# EasyEDA Pro project 第十五届蓝桥杯EDA赛项模拟试题二（嘉立创EDA提供）.eprj, board PCB-PockerMultimater1
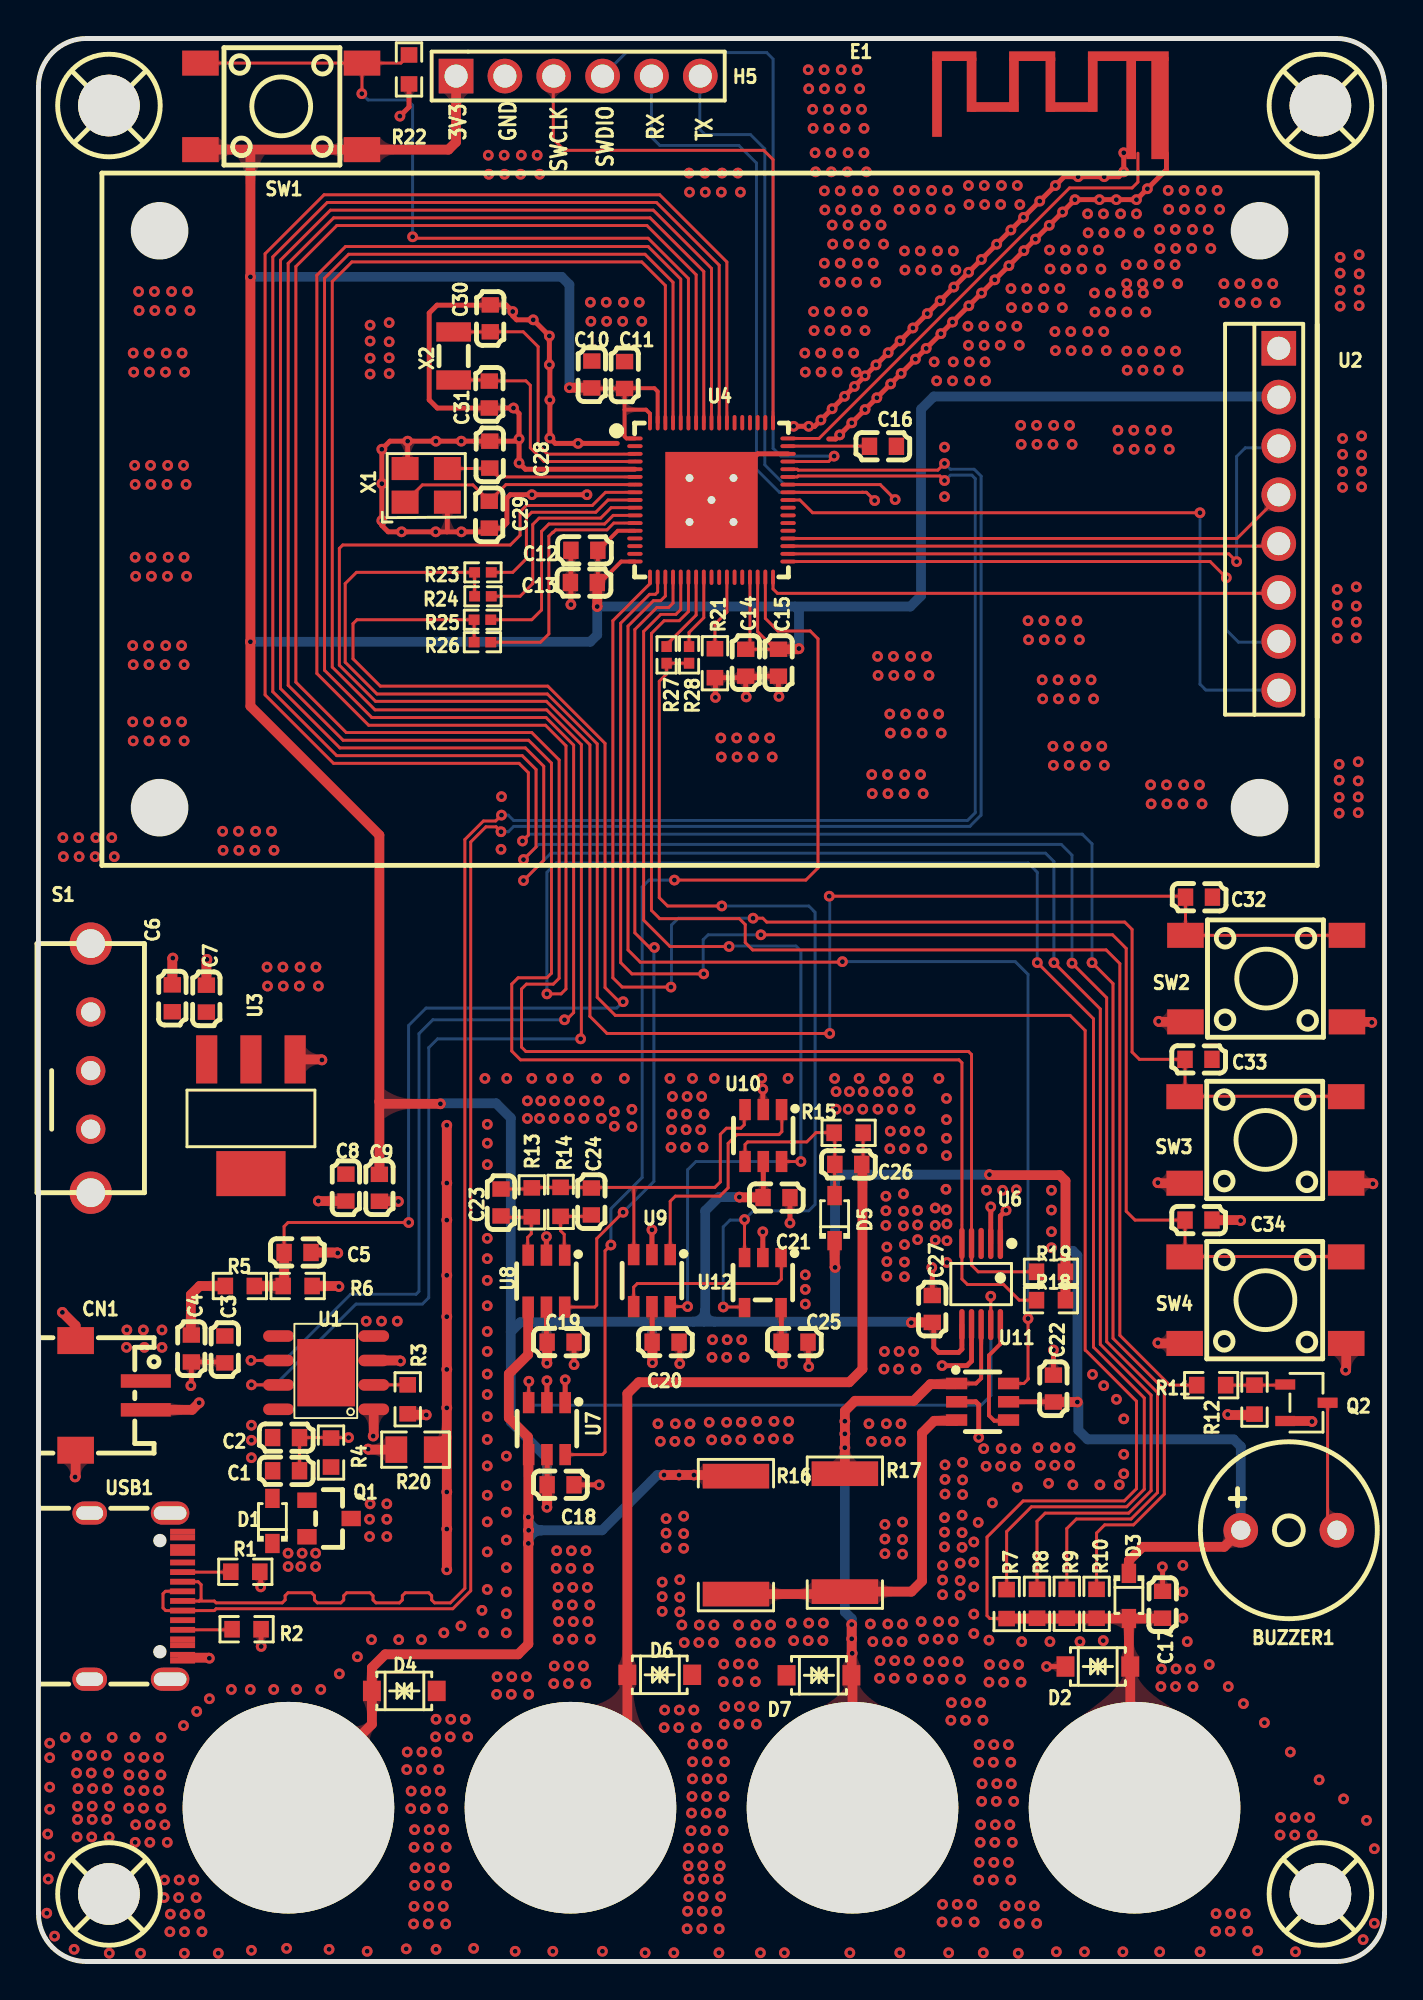
[diagram p1: board, top side]
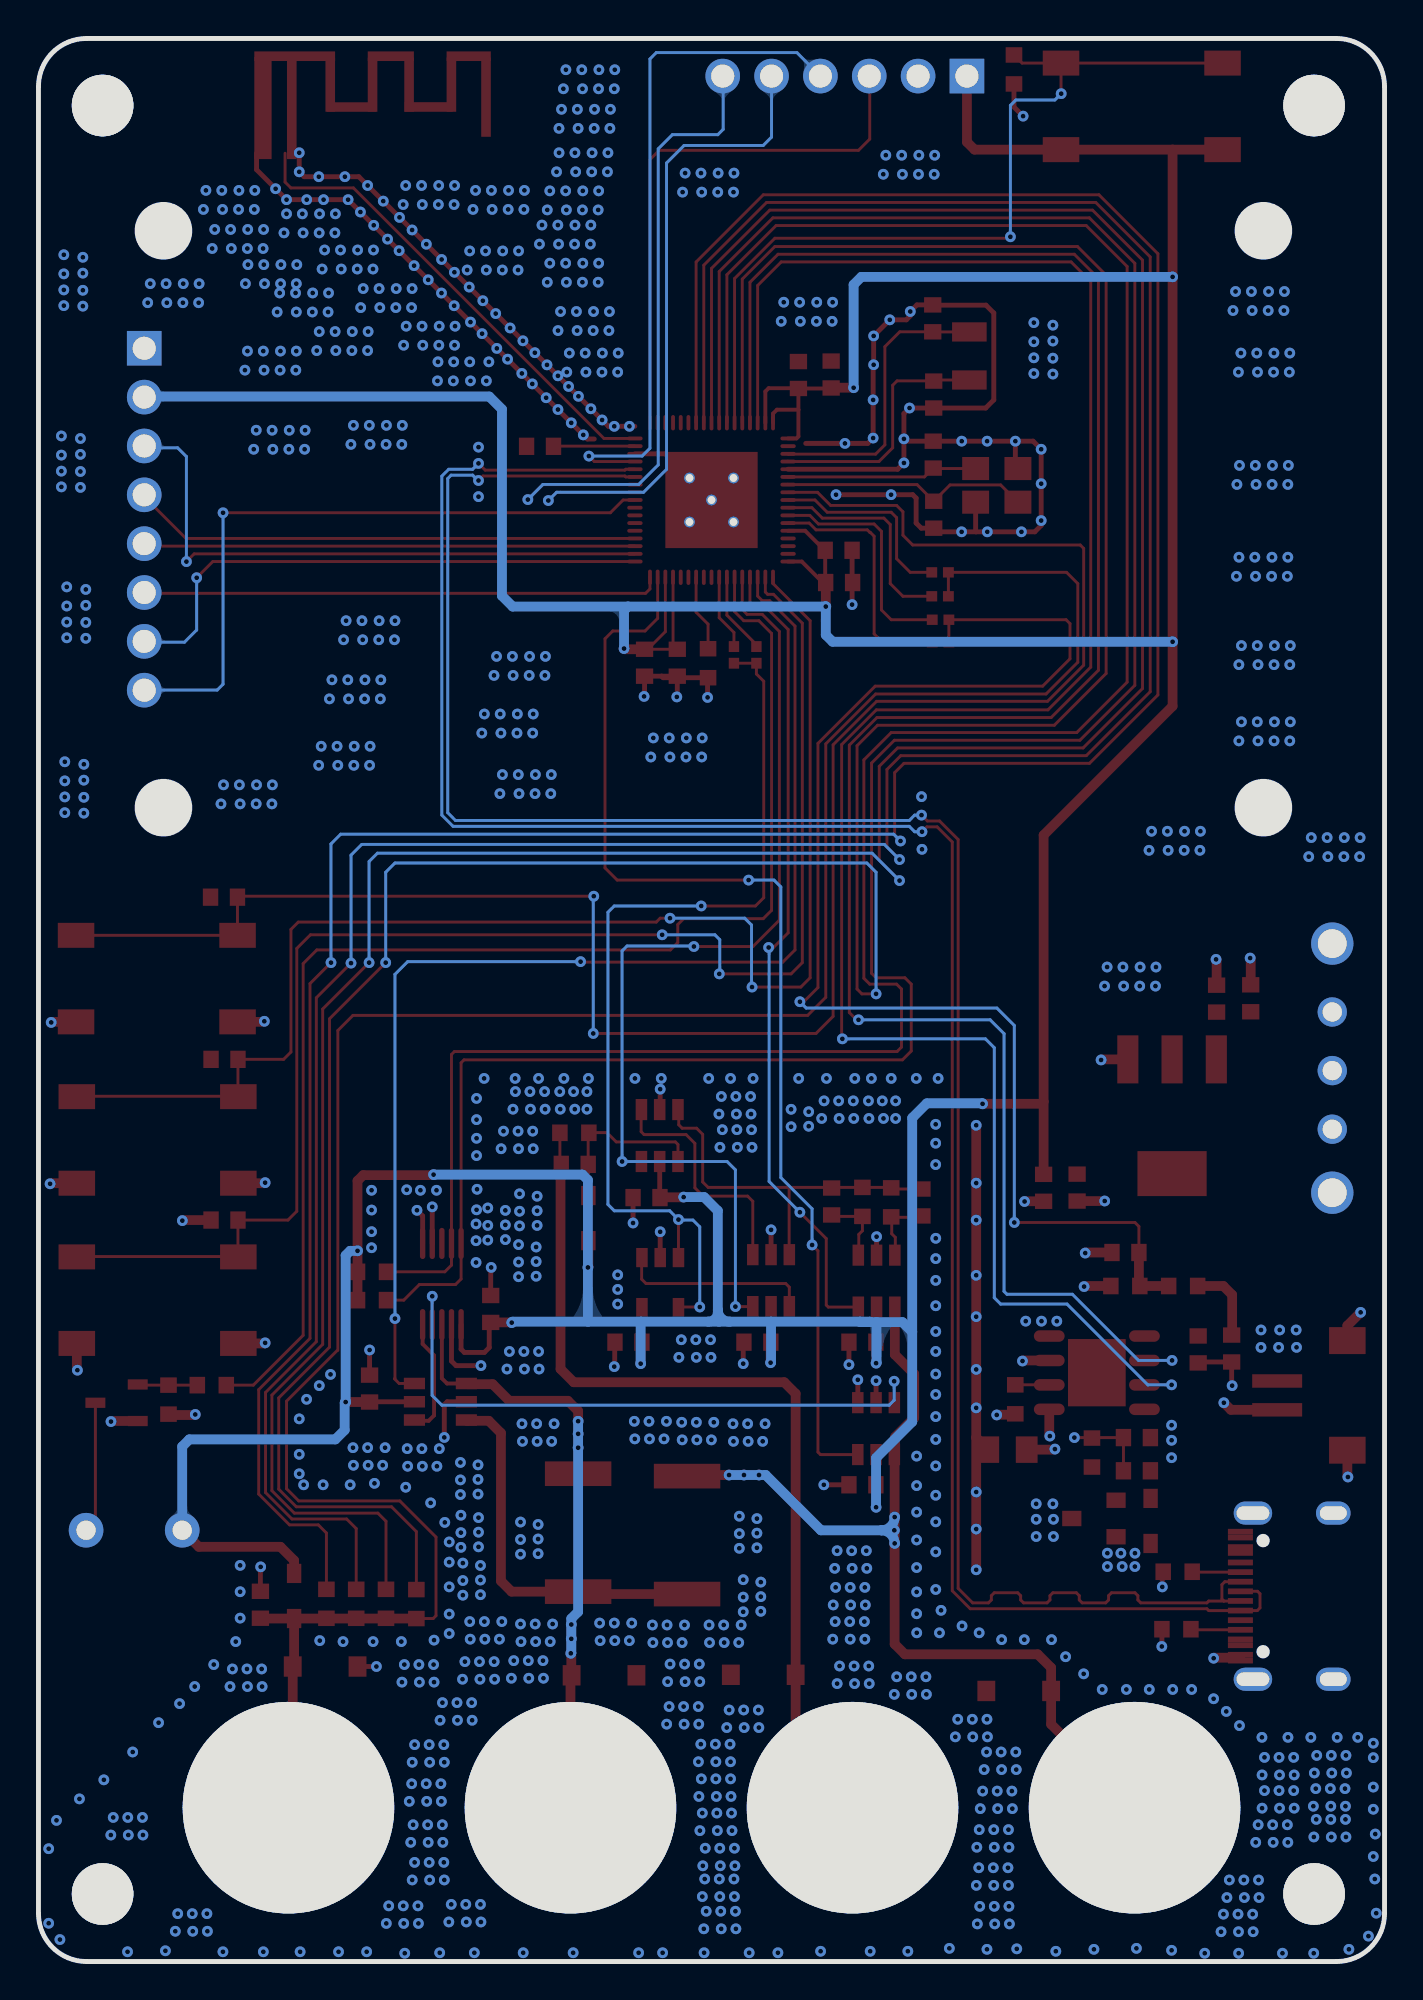
[diagram p2: board, bottom side, seen from below]

Outline 70 x 100 mm; copper layers: Top Layer, Bottom Layer. Coordinates in mm from the lower left corner of the outline.
Outline path: 0,97.5 0,2.5 arc(0.73,0.73) 2.5,0 67.5,0 arc(69.27,0.73) 70,2.5 70,97.5 arc(69.27,99.27) 67.5,100 2.5,100 arc(0.73,99.27) 0,97.5
Stack: Top Layer 0.035mm / Dielectric1 1.51mm FR4 er 4.5 / Bottom Layer 0.035mm

## Design rules (mm)
net VIN: power
net GND: power
net VBUS: power
net USB1DM: DP1
net USB1DP: DP1
net 3V3: power
net VBAT: power
net +5V: power
net AGND: power
template: 自定义配置
spacing copperThickness1oz (default): track to track 0.152, other pairs 0.152 to 0.152
spacing copperThickness2oz: track to track 0.203, other pairs 0.152 to 0.3
spacing ANT: track to track 0.152, other pairs 0 to 0.3
track width copperThickness1oz (default): min 0.152, default 0.152, max 2.54
track width copperThickness2oz: min 0.203, default 0.254, max 2.54
track width power: min 0.152, default 0.254, max 2.54
differential pair differentialPair (default): width min 0.152, default 0.152, max 0.152; gap min 0.152, default 0.152
via viaSize (default): diameter min 0.559, default 0.559, max 0.559; hole min 0.254, default 0.254, max 0.254
net class power uses power
net VIN uses power
net GND uses power
net VBUS uses power
net 3V3 uses power
net VBAT uses power
net +5V uses power
net AGND uses power

## Placement (name value [footprint] x y rotation side)
BUZZER1  3kHz  [BUZ-TH_BD9.0-P5.00-D0.6-FD]  65.02 22.43 0 top
C1  10uF  [C0603]  12.88 25.52 180 top
C2  100nF  [C0603]  12.88 27.25 180 top
C3  10uF  [C0603]  9.69 31.83 90 top
C4  100nF  [C0603]  7.95 31.88 90 top
C5  100nF  [C0603]  13.47 36.87 0 top
C6  10uF  [C0603]  6.96 50.09 270 top
C7  100nF  [C0603]  8.73 50.07 90 top
C8  10uF  [C0603]  15.99 40.25 90 top
C9  100nF  [C0603]  17.73 40.23 270 top
C10  100nF  [C0603]  28.78 82.52 90 top
C11  100nF  [C0603]  30.48 82.5 270 top
C12  100nF  [C0603]  28.39 73.39 180 top
C13  100nF  [C0603]  28.36 71.71 180 top
C14  100nF  [C0603]  36.78 67.54 270 top
C15  100nF  [C0603]  38.48 67.54 270 top
C16  1uF  [C0603]  43.92 78.79 0 top
C17  100nF  [C0603]  58.46 18.55 270 top
C18  100nF  [C0603]  27.15 24.79 0 top
C19  100nF  [C0603]  27.15 32.21 0 top
C20  100nF  [C0603]  32.61 32.21 0 top
C21  100nF  [C0603]  38.38 39.73 0 top
C22  100nF  [C0603]  52.78 29.79 90 top
C23  100nF  [C0603]  24.05 39.47 90 top
C24  100nF  [C0603]  28.75 39.52 90 top
C25  100nF  [C0603]  39.32 32.21 0 top
C26  100nF  [C0603]  42.11 41.45 180 top
C27  100nF  [C0603]  46.48 33.93 90 top
C28  12pF  [C0603]  23.47 78.36 90 top
C29  12pF  [C0603]  23.44 75.23 90 top
C30  12pF  [C0603]  23.5 85.45 90 top
C31  12pF  [C0603]  23.44 81.48 270 top
C32  100nF  [C0603]  60.35 55.35 180 top
C33  100nF  [C0603]  60.32 46.91 180 top
C34  100nF  [C0603]  60.32 38.56 180 top
CN1  1.5K-BH-2PWB  [CONN-SMD_2P-P1.50_HDGC_1.5K-BH-2PWB]  3.76 29.44 270 top
D1  1N5819WS  [SOD-323_L1.8-W1.3-LS2.5-RD]  12.17 22.91 90 top
D2  SJD12C40L01  [SOD-123_L2.8-W1.8-LS3.7-BI]  55.09 15.34 0 top
D3  1N4148  [SOD-323_L1.8-W1.3-LS2.5-RD]  56.71 19.01 270 top
D4  SJD12C40L01  [SOD-123_L2.8-W1.8-LS3.7-BI]  19.02 14.07 180 top
D5  1N4148  [SOD-323_L1.8-W1.3-LS2.5-RD]  41.4 38.66 90 top
D6  SJD12C40L01  [SOD-123_L2.8-W1.8-LS3.7-BI]  32.31 14.91 180 top
D7  SJD12C40L01  [SOD-123_L2.8-W1.8-LS3.7-BI]  40.59 14.88 0 top
E1  d62bb7b376ef4f1495932ffa50be4b9b  [ANT-F-1-2.4G-1.6]  57.18 94.03 0 top
H1  -  [M3]  3.5 96.5 0 top
H2  -  [M3]  66.5 96.5 0 top
H3  -  [M3]  3.5 3.5 0 top
H4  -  [M3]  66.5 3.5 0 top
H5  2.54-1x6P直针  [HDR-TH_6P-P2.54-V-M-1]  28.07 98.04 0 top
J1  -  [香蕉头-4mm-24.302.*]  13 8 0 top
J2  -  [香蕉头-4mm-24.302.*]  27.67 8 0 top
J3  -  [香蕉头-4mm-24.302.*]  42.33 8 0 top
J4  -  [香蕉头-4mm-24.302.*]  57 8 0 top
Q1  AO3401A  [SOT-23_L2.9-W1.3-P1.90-LS2.4-BR]  15.11 23.04 180 top
Q2  S8050  [SOT-23-3_L3.0-W1.7-P0.95-LS2.9-BR]  65.94 29.06 180 top
R1  5.1kΩ  [R0603]  10.76 20.27 180 top
R2  5.1kΩ  [R0603]  10.82 17.28 180 top
R3  10kΩ  [R0603]  19.2 29.24 90 top
R4  10kΩ  [R0603]  15.21 26.47 270 top
R5  10kΩ  [R0603]  10.47 35.13 180 top
R6  10kΩ  [R0603]  13.48 35.13 180 top
R7  1kΩ  [R0603]  50.35 18.59 90 top
R8  10kΩ  [R0603]  51.93 18.6 90 top
R9  100kΩ  [R0603]  53.48 18.6 90 top
R10  1MΩ  [R0603]  55.03 18.6 90 top
R11  10kΩ  [R0603]  60.99 29.97 0 top
R12  10kΩ  [R0603]  63.24 29.22 90 top
R13  100kΩ  [R0603]  25.65 39.48 90 top
R14  1MΩ  [R0603]  27.15 39.5 90 top
R15  1MΩ  [R0603]  42.13 43.09 180 top
R16  10mΩ  [R2512]  36.27 22.17 90 top
R17  80mΩ  [R2512]  41.94 22.3 270 top
R18  4.7kΩ  [R0603]  52.65 34.39 0 top
R19  4.7kΩ  [R0603]  52.65 35.86 0 top
R20  0Ω  [R0805]  19.61 26.62 180 top
R21  10kΩ  [R0603]  35.18 67.51 270 top
R22  10kΩ  [R0603]  19.27 98.39 270 top
R23  0Ω  [R0402]  23.11 72.24 0 top
R24  0Ω  [R0402]  23.11 70.99 0 top
R25  0Ω  [R0402]  23.09 69.77 0 top
R26  0Ω  [R0402]  23.09 68.61 0 top
R27  0Ω  [R0402]  32.66 67.94 90 top
R28  0Ω  [R0402]  33.83 67.94 90 top
S1  SK-12E12-G5  [SW-TH_SK-12E12-G5]  2.72 46.46 180 top
SW1  TS-1002S-07026C  [KEY-SMD_4P-L6.0-W6.0-P4.50-LS9.0]  12.62 96.47 180 top
SW2  TS-1002S-07026C  [KEY-SMD_4P-L6.0-W6.0-P4.50-LS9.0]  63.85 51.11 0 top
SW3  TS-1002S-07026C  [KEY-SMD_4P-L6.0-W6.0-P4.50-LS9.0]  63.81 42.72 0 top
SW4  TS-1002S-07026C  [KEY-SMD_4P-L6.0-W6.0-P4.50-LS9.0]  63.81 34.39 0 top
U1  TP4056X-42-ESOP8  [TP4056-SOP8]  14.96 30.62 0 top
U2  -  [2.0寸TFT屏幕模块-8Pin]  35 75 270 top
U3  AMS1117-3.3  [SOT-223-3_L6.5-W3.4-P2.30-LS7.0-BR]  11.05 43.94 90 top
U4  7693da239a7c4f18baa0651e8e27e4a9  [QFN68(8x8)]  35 76 270 top
U6  INA226AIDGSR  [MSOP-10_L3.0-W3.0-P0.50-LS5.0-BL]  49.02 35.23 180 top
U7  SN74LVC1G3157DBVR  [SOT-23-6_L2.9-W1.6-P0.95-LS2.8-BR]  26.44 27.71 90 top
U8  SN74LVC1G3157DBVR  [SOT-23-6_L2.9-W1.6-P0.95-LS2.8-BR]  26.42 35.38 90 top
U9  SN74LVC1G3157DBVR  [SOT-23-6_L2.9-W1.6-P0.95-LS2.8-BR]  31.9 35.41 90 top
U10  SN74LVC1G3157DBVR  [SOT-23-6_L2.9-W1.6-P0.95-LS2.8-BR]  37.69 42.95 90 top
U11  SN74LVC1G3157DBVR  [SOT-23-6_L2.9-W1.6-P0.95-LS2.8-BR]  49.1 29.11 180 top
U12  LMV321IDBVR  [SOT-23-5_L3.0-W1.7-P0.95-LS2.8-BR]  37.67 35.31 90 top
USB1  KH-TYPE-C-16P  [USB-C-SMD_KH-TYPE-C-16P]  5.08 19 270 top
X1  32MHz  [OSC-SMD_4P-L3.2-W2.5-BL]  20.16 76.76 0 top
X2  32.768kHz  [FC-135R_L3.2-W1.5]  21.59 83.49 90 top

## Footprints (pads in the part's own frame, mm; a bottom-side part is the same pattern mirrored in y, then rotated)
2.0寸TFT屏幕模块-8Pin
  rect 1.8x1.8 hole 1.2: 1(-8.89,29.5)
  round 1.8 hole 1.2: 2(-6.35,29.5) 3(-3.81,29.5) 4(-1.27,29.5) 5(1.27,29.5) 6(3.81,29.5) 7(6.35,29.5) 8(8.89,29.5)
ANT-F-1-2.4G-1.6
  rect 0.8x0.6 smd: 0(1.143,0)
  rect 0.4x0.6 smd: 1(-0.34,0)
BUZ-TH_BD9.0-P5.00-D0.6-FD
  round 1.8 hole 1: 1(-2.5,0) 2(2.5,0)
C0603
  rect 0.8x0.9 smd: 1(-0.7,0) 2(0.7,0)
CONN-SMD_2P-P1.50_HDGC_1.5K-BH-2PWB
  rect 0.7x2.6 smd: 1(-0.75,1.825) 2(0.75,1.825)
  rect 1.4x1.9 smd: 3(2.85,-1.825) 4(-2.85,-1.825)
FC-135R_L3.2-W1.5
  rect 1x1.8 smd: 1(-1.25,0) 2(1.25,0)
HDR-TH_6P-P2.54-V-M-1
  rect 1.8x1.8 hole 1.2: 1(-6.35,0)
  round 1.8 hole 1.2: 2(-3.81,0) 3(-1.27,0) 4(1.27,0) 5(3.81,0) 6(6.35,0)
KEY-SMD_4P-L6.0-W6.0-P4.50-LS9.0
  rect 1.9x1.3 smd: 1(-4.2,2.25) 2(4.2,2.25) 3(-4.2,-2.25) 4(4.2,-2.25)
M3
  round 3.2 hole 3.2: 0(0.165,0.013)
MSOP-10_L3.0-W3.0-P0.50-LS5.0-BL
  oval 0.28x1.62 smd: 1(-1,-2.11) 2(-0.5,-2.11) 3(0,-2.11) 4(0.5,-2.11) 5(1,-2.11) 6(1,2.11) 7(0.5,2.11) 8(0,2.11) 9(-0.5,2.11) 10(-1,2.11)
OSC-SMD_4P-L3.2-W2.5-BL
  rect 1.4x1.2 smd: 1(-1.1,-0.875) 2(1.1,-0.875) 3(1.1,0.875) 4(-1.1,0.875)
QFN68(8x8)
  round 0.559 hole 0.406: 0(-1.143,1.143) 0(-1.143,-1.143) 0(0,0) 0(1.143,1.143) 0(1.143,-1.143)
  rect 5x4.8 smd: 0(0,0)
  oval 0.2x0.8 smd: 1(-3.2,-3.982) 2(-2.8,-3.982) 3(-2.4,-3.982) 4(-2,-3.982) 5(-1.6,-3.982) 6(-1.2,-3.982) 7(-0.8,-3.982) 8(-0.4,-3.982) 9(0,-3.982) 10(0.4,-3.982) 11(0.8,-3.982) 12(1.2,-3.982) 13(1.6,-3.982) 14(2,-3.982) 15(2.4,-3.982) 16(2.8,-3.982) 17(3.2,-3.982) 35(3.2,3.982) 36(2.8,3.982) 37(2.4,3.982) 38(2,3.982) 39(1.6,3.982) 40(1.2,3.982) 41(0.8,3.982) 42(0.4,3.982) 43(0,3.982) 44(-0.4,3.982) 45(-0.8,3.982) 46(-1.2,3.982) 47(-1.6,3.982) 48(-2,3.982) 49(-2.4,3.982) 50(-2.8,3.982) 51(-3.2,3.982)
  oval 0.8x0.2 smd: 18(4.018,-3.2) 19(4.018,-2.8) 20(4.018,-2.4) 21(4.018,-2) 22(4.018,-1.6) 23(4.018,-1.2) 24(4.018,-0.8) 25(4.018,-0.4) 26(4.018,0) 27(4.018,0.4) 28(4.018,0.8) 29(4.018,1.2) 30(4.018,1.6) 31(4.018,2) 32(4.018,2.4) 33(4.018,2.8) 34(4.018,3.2) 52(-4.018,3.2) 53(-4.018,2.8) 54(-4.018,2.4) 55(-4.018,2) 56(-4.018,1.6) 57(-4.018,1.2) 58(-4.018,0.8) 59(-4.018,0.4) 60(-4.018,0) 61(-4.018,-0.4) 62(-4.018,-0.8) 63(-4.018,-1.2) 64(-4.018,-1.6) 65(-4.018,-2) 66(-4.018,-2.4) 67(-4.018,-2.8) 68(-4.018,-3.2)
R0402
  rect 0.566x0.54 smd: 1(-0.433,0) 2(0.433,0)
R0603
  rect 0.806x0.864 smd: 1(-0.753,0) 2(0.753,0)
R0805
  rect 1.133x1.377 smd: 1(-1,0) 2(1,0)
R2512
  rect 1.282x3.456 smd: 1(-3.067,0) 2(3.067,0)
SOD-123_L2.8-W1.8-LS3.7-BI
  rect 0.93x1.06 smd: 1(1.685,0) 2(-1.685,0)
SOD-323_L1.8-W1.3-LS2.5-RD
  rect 1x0.75 smd: 1(-1.173,0) 2(1.173,0)
SOT-23-3_L3.0-W1.7-P0.95-LS2.9-BR
  rect 1.038x0.532 smd: 1(1.101,-0.95) 2(1.101,0.95) 3(-1.101,0)
SOT-23-5_L3.0-W1.7-P0.95-LS2.8-BR
  rect 1x0.6 smd: 1(1.3,-0.95) 2(1.3,0) 3(1.3,0.95) 4(-1.3,0.95) 5(-1.3,-0.95)
SOT-23-6_L2.9-W1.6-P0.95-LS2.8-BR
  rect 1.1x0.6 smd: 1(1.35,-0.95) 2(1.35,0) 3(1.35,0.95) 4(-1.35,0.95) 5(-1.35,0) 6(-1.35,-0.95)
SOT-23_L2.9-W1.3-P1.90-LS2.4-BR
  rect 1x0.8 smd: 1(1.15,-0.95) 2(1.15,0.95) 3(-1.15,0)
SOT-223-3_L6.5-W3.4-P2.30-LS7.0-BR
  rect 2.5x1.1 smd: 1(2.97,-2.3) 2(2.97,0) 3(2.97,2.3)
  rect 2.34x3.6 smd: 4(-2.97,0)
SW-TH_SK-12E12-G5
  round 1.524 hole 1: 1(0,3.175) 2(0,0.127) 3(0,-2.921)
  round 2.2 hole 1.5: 4(0,-6.477) 5(0,6.477)
TP4056-SOP8
  oval 1.6x0.6 smd: 1(2.475,-1.905) 2(2.475,-0.635) 3(2.475,0.635) 4(2.475,1.905) 5(-2.475,1.905) 6(-2.475,0.635) 7(-2.475,-0.635) 8(-2.475,-1.905)
  rect 3x3.5 smd: 9(0,0)
USB-C-SMD_KH-TYPE-C-16P
  oval 1.2x2 hole 0.7x1.7: 1(-4.32,1.765) 2(4.32,1.765)
  oval 1.2x1.8 hole 0.7x1.4: 3(-4.32,-2.415) 4(4.32,-2.415)
  rect 0.3x1.3 smd: A1(-3.35,2.415) A4(-2.55,2.415) A5(-1.25,2.415) A6(-0.25,2.415) A7(0.25,2.415) A8(1.25,2.415) A9(2.55,2.415) A12(3.35,2.415) B1(3.05,2.415) B4(2.25,2.415) B5(1.75,2.415) B6(0.75,2.415) B7(-0.75,2.415) B8(-1.75,2.415) B9(-2.25,2.415) B12(-3.05,2.415)
香蕉头-4mm-24.302.*
  round 11 hole 12.2x6.1: 1(0,0)

## Nets
As in the schematic.

Pads without a net: E1 0; H1 0; H2 0; H3 0; H4 0; S1 1; U4 2 14 15 16 26 27 29 30 39 40 41 42 53 54 55 56 57; U6 3; USB1 A8 B8

## Via types
v1: diameter 0.559, hole 0.254, Top Layer to Bottom Layer, 1220 vias

## Routing (per net, layer and track width the routed paths; a pad name or vN(x,y) marks a point on that pad's centre or on a via; arc(x,y) is an arc through that point)
3V3: length 339.6
  Top Layer w0.152: 38.31,68.24 37.4,69.15 U4.32 ; 38.31,68.24 C14.1 37,68.46 U4.31 ; 38.31,68.24 C15.1
  Top Layer w0.203: U4.13 30.13,74.4 29.11,73.39 C12.1 29.09,71.73 C13.1 29.21,71.71 30.31,72.8 U4.17 ; 30.48,81.8 28.87,81.8 28.84,81.82 C10.1 ; 30.48,81.8 30.49,81.81 32.03,81.81 32.2,81.64 U4.67 ; 30.48,81.8 30.48,80.7 ; U4.68 31.8,80.49 31.6,80.7 30.48,80.7 ; U4.1 30.58,79.2 30.48,79.3 30.48,80.7
  Top Layer w0.254: U8.5 26.42,32.24 C19.1 ; 46.15,33.08 46.53,33.08 46.56,33.11 46.56,31.93 46.81,31.67 47.85,31.67 48.02,31.84 U6.6 ; U12.5 38.63,33.99 38.63,32.2 ; C21.1 37.69,39.74 U10.5 ; U7.5 26.45,26.35 C18.1 ; C22.1 52.77,29.11 U11.5 ; C20.1 31.91,34.05 U9.5
  Top Layer w0.508: 38.63,32.2 38.68,32.14 v1(38.68,31.09) ; C15.1 39.51,68.24 v1(39.55,68.28) ; v1(20.9,44.6) 17.84,44.6 17.73,44.72 ; H5.1 21.72,94.61 21.32,94.22 SW1.1 11.02,94.22 ; v1(27.61,81.84) 28.76,81.84 C10.1 ; v1(29.06,70.46) 29.06,71.7 C13.1 ; v1(26.44,23.62) 26.45,23.63 C18.1 26.44,24.78 ; v1(31.93,31.14) 31.93,32.19 C20.1 ; SW1.2 11.02,94.22 ; 11.02,94.22 v1(11.02,87.6) v1(11.02,68.63) 11.02,65.28 17.73,58.57 17.73,44.72 ; BUZZER1.1 61.66,21.56 57.41,21.56 56.71,20.86 D3.1 ; v1(49.45,40.92) 49.48,40.89 53.11,40.89 53.41,40.6 v1(53.41,36.96) R19.2 R18.2 ; D5.1 41.4,36.12 v1(41.43,36.09) ; 17.73,44.72 C9.1 ; v1(45.39,33.22) 45.4,33.23 C27.1 ; C19.1 26.45,31.13 v1(26.44,31.12) ; 37.69,39.74 36.46,39.74 v1(36.45,39.75) ; C22.1 v1(54.03,29.09)
  Bottom Layer w0.508: 24.56,32.74 24.56,43.87 23.8,44.63 20.93,44.63 v1(20.9,44.6) ; 24.56,32.74 25.07,33.25 26.42,33.25 ; 24.56,32.74 24.56,28.07 26.44,26.19 v1(26.44,23.62) ; BUZZER1.1 62.52,26.78 62.15,27.15 54.56,27.15 54.08,27.63 54.08,29.04 v1(54.03,29.09) 54.03,36.72 53.79,36.96 v1(53.41,36.96) ; v1(31.93,31.14) 31.9,31.17 31.9,33.27 ; 34.06,33.27 31.9,33.27 ; 34.06,33.27 34.61,33.27 ; 34.06,33.27 arc(34.49,33.45) 34.67,33.88 ; 31.9,33.27 27.28,33.27 ; 27.28,33.27 26.77,33.27 26.75,33.25 ; 27.28,33.27 27.25,33.25 26.75,33.25 ; 26.42,33.25 26.42,31.14 v1(26.44,31.12) ; 26.42,33.25 26.75,33.25 ; v1(11.02,68.63) 28.7,68.63 29.06,68.99 v1(29.06,70.46) 39.34,70.46 ; 35.16,33.27 34.61,33.27 ; 35.16,33.27 38.68,33.27 ; 35.16,33.27 arc(34.81,33.42) 34.67,33.76 ; 34.61,33.27 34.67,33.33 34.67,33.76 ; 38.68,33.27 v1(38.68,31.09) ; 38.68,33.27 41.43,33.27 ; 41.43,33.27 45.34,33.27 v1(45.39,33.22) ; 41.43,33.27 v1(41.43,36.09) 41.43,40.64 41.71,40.92 v1(49.45,40.92) ; 39.34,70.46 45.34,70.46 45.9,71.02 45.9,80.72 46.56,81.38 64.57,81.38 64.6,81.35 ; 39.34,70.46 39.55,70.26 v1(39.55,68.28) ; 34.67,33.88 34.67,39.04 35.38,39.75 v1(36.45,39.75) ; 34.67,33.88 34.67,33.76 ; v1(27.61,81.84) 27.61,87.2 27.21,87.6 v1(11.02,87.6)
+5V:
  vias: v1(12.98,21.23) v1(12.98,20.54) v1(13.64,20.54) v1(13.71,21.23) v1(14.41,21.23) v1(14.41,20.54)
AGND: length 52.5
  Top Layer w0.254: U6.2 v1(49.52,39.24) ; v1(48.9,27.25) 48.9,28.96 48.74,29.11 U11.2 ; C22.2 v1(52.78,31.8) ; D2.2 v1(52.43,15.34) ; v1(50.32,39.06) 50.02,38.77 U6.1 ; C27.2 46.48,36.07 v1(46.46,36.09) ; U7.1 v1(27.39,30.25) ; C20.2 33.35,32.17 v1(33.35,31.09) ; U12.2 v1(37.67,37.95) ; U9.2 v1(31.9,38.05) ; v1(40.06,30.94) 40.03,30.96 40.03,32.2 ; 27.8,24.79 v1(29.16,24.79) ; U10.2 37.67,44.33 v1(37.67,45.36) ; C19.2 v1(27.85,31.04) ; v1(46.99,30.99) 48.29,30.99 48.52,31.22 U6.7 ; U8.2 v1(26.42,37.69) ; v1(58.45,20.52) 58.46,20.51 C17.1 ; U7.2 v1(26.44,30.2) ; C21.2 v1(39.08,38.41)
  Top Layer w0.508: R20.1 21.23,27.25 ; 21.23,27.25 v1(21.23,24.42) v1(21.23,22.49) v1(21.23,20.37) ; 21.23,27.25 v1(21.23,28.79) v1(21.23,30.79) v1(21.23,33.53) v1(21.23,35.68) v1(21.23,38.55) v1(21.23,40.48) v1(21.23,43.48)
  Bottom Layer w0.254: v1(37.67,45.36) 37.67,45.29
  vias: v1(0.43,2.51) v1(0.48,6.63) v1(0.51,4.29) v1(0.58,11.35) v1(0.58,10.6) v1(0.58,9.07) v1(0.58,7.92) v1(0.58,5.46) v1(0.84,1.32) v1(1.39,11.66) v1(1.85,0.63) v1(2.01,10.72) v1(1.98,9.8) v1(2.03,8.08) v1(2.03,7.39) v1(2.01,6.48) v1(2.06,8.99) v1(2.46,11.66) v1(2.74,9.8) v1(2.77,10.72) v1(2.82,8.99) v1(2.8,8.08) v1(2.8,7.39) v1(2.77,6.48) v1(3.53,10.72) v1(3.58,8.99) v1(3.55,7.39) v1(3.65,9.8) v1(3.7,8.08) v1(3.68,6.48) v1(3.68,0.43) v1(3.83,11.66) v1(4.72,10.62) v1(4.7,9.7) v1(4.72,8.89) v1(4.7,7.98) v1(5.02,11.66) v1(5.03,6.2) v1(5.05,7.11) v1(5.31,0.43) v1(5.49,10.62) v1(5.46,9.7) v1(5.49,8.89) v1(5.46,7.98) v1(5.82,7.11) v1(5.79,6.2) v1(6.24,10.62) v1(6.24,8.89) v1(6.38,11.66) v1(6.37,9.7) v1(6.37,7.98) v1(6.53,3.33) v1(6.57,7.11) v1(6.55,4.24) v1(6.7,6.2) v1(6.83,1.55) v1(6.86,2.46) v1(7.32,4.24) v1(7.29,3.33) v1(7.54,12.27) v1(7.62,2.46) v1(7.6,1.55) v1(7.59,0.43) v1(8.07,4.24) v1(8.23,13) v1(8.2,3.33) v1(8.38,2.46) v1(8.5,1.55) v1(8.89,13.66) v1(9.35,0.43) v1(10.03,14.15) v1(11.02,14.15) v1(11.07,0.58) v1(12.23,14.15) v1(12.9,0.69) v1(13.43,14.15) v1(14.68,14.15) v1(15.11,0.63) v1(15.65,14.96) v1(16.59,15.85) v1(17.09,0.53) v1(17.32,16.74) v1(18.73,16.74) v1(19.13,0.66) v1(19.18,10.9) v1(19.15,9.98) v1(19.38,8.86) v1(19.35,7.95) v1(19.53,5.94) v1(19.53,2.87) v1(19.51,1.96) v1(19.56,6.86) v1(19.58,4.88) v1(19.56,3.96) v1(19.91,16.74) v1(19.94,10.9) v1(19.91,9.98) v1(20.14,8.86) v1(20.12,7.95) v1(20.32,6.86) v1(20.3,5.94) v1(20.35,4.88) v1(20.32,3.96) v1(20.3,2.87) v1(20.27,1.96) v1(20.68,12.6) v1(20.65,11.68) v1(20.7,10.9) v1(20.68,0.63) v1(20.82,9.98) v1(20.9,8.86) v1(21.02,7.95) v1(21.08,17.09) v1(21.08,6.86) v1(21.1,4.88) v1(21.05,2.87) v1(21.2,5.94) v1(21.23,3.96) v1(21.18,1.96) v1(21.44,12.6) v1(21.41,11.68) v1(21.97,17.45) v1(22.19,12.6) v1(22.32,11.68) v1(22.63,0.69) v1(23.06,18.26) v1(23.15,17.09) v1(23.22,45.92) v1(23.34,43.54) v1(23.34,42.55) v1(23.34,41.44) v1(23.34,37.61) v1(23.34,36.55) v1(23.34,35.42) v1(23.34,34.1) v1(23.34,32.76) v1(23.34,31.72) v1(23.34,30.55) v1(23.34,29.49) v1(23.34,28.34) v1(23.34,27.15) v1(23.34,25.77) v1(23.34,24.25) v1(23.34,22.86) v1(23.34,21.3) v1(23.34,19.35) v1(23.83,13.89) v1(23.85,14.81) v1(24.33,26.28) v1(24.33,24.75) v1(24.33,23.37) v1(24.33,21.92) v1(24.33,20.49) v1(24.33,19.22) v1(24.33,18.09) v1(24.33,17.09) v1(24.35,45.92) v1(24.61,14.81) v1(24.59,13.89) v1(24.79,0.53) v1(25.43,44.75) v1(25.43,43.84) v1(25.37,14.81) v1(25.5,13.89) v1(25.66,45.92) v1(26.12,44.75) v1(26.06,43.84) v1(26.69,45.92) v1(26.75,0.53) v1(26.84,44.75) v1(26.81,43.84) v1(26.82,15.37) v1(26.8,14.45) v1(26.95,21.36) v1(26.92,20.45) v1(27.03,19.46) v1(27,18.54) v1(27.03,16.76) v1(27.05,17.68) v1(27.55,45.92) v1(27.63,44.75) v1(27.6,43.84) v1(27.59,15.37) v1(27.56,14.45) v1(27.71,21.36) v1(27.69,20.45) v1(27.79,19.46) v1(27.76,18.54) v1(27.81,17.68) v1(27.79,16.76) v1(28.34,15.37) v1(28.39,44.75) v1(28.36,43.84) v1(28.47,21.36) v1(28.54,19.46) v1(28.47,14.45) v1(28.59,20.45) v1(28.57,17.68) v1(28.67,18.54) v1(28.7,16.76) v1(29.02,45.92) v1(29.15,44.75) v1(29.27,43.84) v1(29.33,0.53) v1(29.95,44.19) v1(29.95,43.44) v1(30.47,45.92) v1(30.86,44.32) v1(30.86,43.41) v1(31.55,0.46) v1(32.21,27.97) v1(32.34,27.05) v1(32.44,19.73) v1(32.44,18.97) v1(32.44,18.21) v1(32.54,12.17) v1(32.64,23.03) v1(32.64,22.28) v1(32.64,21.51) v1(32.56,13.08) v1(32.84,45.92) v1(32.94,44.07) v1(32.92,43.26) v1(32.89,42.34) v1(32.97,44.98) v1(33.04,0.46) v1(33.12,27.97) v1(33.1,27.05) v1(33.35,19.86) v1(33.35,18.95) v1(33.35,18.19) v1(33.33,13.08) v1(33.3,12.17) v1(33.46,17.5) v1(33.55,23.16) v1(33.55,22.25) v1(33.55,21.49) v1(33.58,16.59) v1(33.73,44.98) v1(33.71,44.07) v1(33.68,43.26) v1(33.66,42.34) v1(33.73,1.7) v1(33.81,5.89) v1(33.78,4.98) v1(33.83,4.29) v1(33.81,3.38) v1(33.76,2.62) v1(33.88,27.97) v1(33.86,27.05) v1(33.94,6.81) v1(34.01,45.92) v1(34.04,11.3) v1(34.01,10.39) v1(34.01,9.5) v1(33.99,8.59) v1(33.96,7.72) v1(34.08,13.08) v1(34.21,12.17) v1(34.34,16.59) v1(34.44,43.26) v1(34.37,17.5) v1(34.49,44.98) v1(34.54,4.98) v1(34.52,2.62) v1(34.49,1.7) v1(34.61,44.07) v1(34.56,42.34) v1(34.57,5.89) v1(34.6,4.29) v1(34.57,3.38) v1(34.75,8.59) v1(34.72,7.72) v1(34.7,6.81) v1(34.8,11.3) v1(34.77,10.39) v1(34.77,9.5) v1(34.88,28.04) v1(35.03,31.42) v1(35.01,27.13) v1(35.15,45.92) v1(35.05,32.33) v1(35.13,17.5) v1(35.1,16.59) v1(35.33,5.89) v1(35.28,2.62) v1(35.35,4.29) v1(35.4,1.7) v1(35.39,0.46) v1(35.53,9.5) v1(35.48,7.72) v1(35.45,4.98) v1(35.48,3.38) v1(35.64,15.47) v1(35.61,14.55) v1(35.56,11.3) v1(35.6,6.81) v1(35.69,13.26) v1(35.66,12.34) v1(35.68,10.39) v1(35.66,8.59) v1(35.81,32.33) v1(35.79,31.42) v1(35.79,28.04) v1(35.76,27.13) v1(36.41,17.5) v1(36.4,15.47) v1(36.37,14.55) v1(36.45,13.26) v1(36.43,12.34) v1(36.53,27.13) v1(36.53,16.59) v1(36.57,32.33) v1(36.55,28.04) v1(36.7,31.42) v1(37.16,15.47) v1(37.21,13.26) v1(37.34,28.09) v1(37.31,17.5) v1(37.29,16.59) v1(37.28,14.55) v1(37.33,12.34) v1(37.47,27.18) v1(37.54,0.46) v1(37.61,45.92) v1(38.05,16.59) v1(38.07,17.5) v1(38.23,27.18) v1(38.25,28.09) v1(38.79,0.46) v1(38.98,45.92) v1(39.01,28.09) v1(38.99,27.18) v1(39.15,17.6) v1(39.27,16.69) v1(39.88,35.71) v1(39.88,34.95) v1(39.88,34.19) v1(40.03,16.69) v1(40.05,17.6) v1(40.82,17.6) v1(40.79,16.69) v1(41.4,45.92) v1(41.48,45.24) v1(41.48,44.32) v1(42.11,44.32) v1(42.17,45.24) v1(42.19,0.46) v1(42.68,45.92) v1(42.89,45.24) v1(42.87,44.32) v1(43.19,27.97) v1(43.31,27.05) v1(43.26,17.55) v1(43.39,16.64) v1(43.68,45.24) v1(43.65,44.32) v1(43.74,14.73) v1(43.76,15.65) v1(43.99,45.92) v1(43.99,31.72) v1(43.97,30.81) v1(44.02,22.73) v1(44.02,21.97) v1(44.02,21.21) v1(44.07,39.8) v1(44.07,39.04) v1(44.07,38.28) v1(44.12,37.16) v1(44.12,36.4) v1(44.12,35.64) v1(44.09,27.97) v1(44.07,27.05) v1(44.14,16.64) v1(44.17,17.55) v1(44.3,43.18) v1(44.27,42.27) v1(44.44,45.24) v1(44.42,44.32) v1(44.53,15.65) v1(44.5,14.73) v1(44.73,30.81) v1(44.76,31.72) v1(44.83,27.05) v1(44.79,0.46) v1(44.86,27.97) v1(44.93,22.85) v1(44.93,21.95) v1(44.93,21.18) v1(44.93,17.55) v1(44.91,16.64) v1(45.04,42.27) v1(44.98,39.92) v1(44.98,39.02) v1(44.98,38.25) v1(45.03,37.28) v1(45.03,36.37) v1(45.03,35.61) v1(45.06,43.18) v1(45.21,45.92) v1(45.2,45.24) v1(45.32,44.32) v1(45.28,15.65) v1(45.41,14.73) v1(45.51,31.72) v1(45.64,30.81) v1(45.72,39.06) v1(45.72,38.3) v1(45.72,37.54) v1(45.82,43.18) v1(45.94,42.27) v1(45.9,17.68) v1(46.03,16.76) v1(46.3,15.6) v1(46.28,14.68) v1(46.63,39.19) v1(46.63,38.28) v1(46.63,37.52) v1(46.82,45.92) v1(46.81,17.68) v1(46.79,16.76) v1(47.02,20.59) v1(47.02,19.84) v1(47.02,19.08) v1(47.04,14.68) v1(47.02,2.97) v1(46.99,2.06) v1(47.14,25.83) v1(47.14,25.07) v1(47.14,24.31) v1(47.12,23.08) v1(47.12,22.33) v1(47.12,21.56) v1(47.07,15.6) v1(47.22,44.88) v1(47.22,43.78) v1(47.22,42.81) v1(47.22,41.91) v1(47.19,40.16) v1(47.22,39.09) v1(47.24,38.35) v1(47.24,37.48) v1(47.24,36.35) v1(47.33,0.46) v1(47.45,12.55) v1(47.55,16.76) v1(47.47,13.46) v1(47.57,17.68) v1(47.82,15.6) v1(47.78,2.97) v1(47.75,2.06) v1(47.93,20.72) v1(47.93,19.81) v1(47.93,19.05) v1(47.95,14.68) v1(48.03,23.21) v1(48.03,22.3) v1(48.03,21.54) v1(48.06,25.95) v1(48.06,25.05) v1(48.06,24.28) v1(48.24,13.46) v1(48.21,12.55) v1(48.53,2.97) v1(48.64,21.82) v1(48.64,20.77) v1(48.64,19.48) v1(48.64,18.07) v1(48.64,17.06) v1(48.66,2.06) v1(48.87,22.83) v1(48.92,11.28) v1(48.9,10.36) v1(48.92,5.16) v1(48.9,4.24) v1(48.99,13.46) v1(49.05,8.33) v1(49,7.11) v1(48.97,6.2) v1(49.12,12.55) v1(49.07,9.25) v1(49.13,0.46) v1(49.16,26.67) v1(49.3,40.11) v1(49.28,25.76) v1(49.43,16.71) v1(49.43,14.53) v1(49.45,15.44) v1(49.61,23.85) v1(49.68,11.28) v1(49.66,10.36) v1(49.73,6.2) v1(49.68,5.16) v1(49.66,4.24) v1(49.84,9.25) v1(49.81,8.33) v1(49.76,7.11) v1(50.04,25.76) v1(50.14,40.11) v1(50.06,26.67) v1(50.22,15.44) v1(50.19,14.53) v1(50.24,1.98) v1(50.27,2.9) v1(50.44,11.28) v1(50.44,5.16) v1(50.52,7.11) v1(50.56,10.36) v1(50.59,9.25) v1(50.64,6.2) v1(50.56,4.24) v1(50.72,8.33) v1(50.82,26.67) v1(50.8,25.76) v1(50.85,40.13) v1(50.9,24.66) v1(50.97,15.44) v1(51.03,2.9) v1(51,1.98) v1(50.95,0.43) v1(51.13,16.64) v1(51.1,14.53) v1(51.79,2.9) v1(51.91,1.98) v1(51.97,26.72) v1(52.1,25.81) v1(52.53,24.87) v1(52.6,16.64) v1(52.68,40.11) v1(52.68,39.08) v1(52.68,37.95) v1(52.68,37.12) v1(52.88,26.72) v1(52.86,25.81) v1(52.93,0.51) v1(53.64,26.72) v1(53.62,25.81) v1(53.79,24.79) v1(54.16,16.64) v1(54.4,0.51) v1(54.81,30.53) v1(55.2,24.79) v1(55.4,29.95) v1(55.37,16.69) v1(56.06,29.24) v1(56.21,24.79) v1(56.44,28.22) v1(56.44,26.38) v1(56.44,25.36) v1(56.39,0.51) v1(58.31,0.51) v1(58.39,15.21) v1(58.37,14.3) v1(59.13,14.3) v1(59.16,15.21) v1(59.51,20.6) v1(59.51,19.23) v1(59.51,17.86) v1(59.74,16.64) v1(59.91,15.21) v1(60.04,14.3) v1(60.41,0.51) v1(60.88,15.44) v1(61.24,2.49) v1(61.21,1.57) v1(61.87,14.3) v1(62,2.49) v1(61.98,1.57) v1(62.66,13.41) v1(62.76,2.49) v1(62.88,1.57) v1(63.4,0.56) v1(63.75,12.42) v1(64.59,7.49) v1(64.57,6.58) v1(65.1,10.9) v1(65.33,6.58) v1(65.35,7.49) v1(65.37,0.51) v1(66.11,7.49) v1(66.24,6.58) v1(66.6,9.45) v1(67.87,8.46) v1(68.88,1.14) v1(69.06,7.34) v1(69.47,5.87) v1(69.47,1.99)